# EAGLE schematic Resistor_Resistor (EAGLE 8.3.0), part 4 of 43
## Parts (continued)
R4401  10K  RESISTOR_0201  [0201]
R4402  10K  RESISTOR_0201  [0201]
R4403  10K  RESISTOR_0201  [0201]
R4404  10K  RESISTOR_0201  [0201]
R4405  10K  RESISTOR_0201  [0201]
R4406  10K  RESISTOR_0201  [0201]
R4407  10K  RESISTOR_0201  [0201]
R4408  10K  RESISTOR_0201  [0201]
R4409  10K  RESISTOR_0201  [0201]
R4410  10K  RESISTOR_0201  [0201]
R4411  10K  RESISTOR_0201  [0201]
R4412  10K  RESISTOR_0201  [0201]
R4413  10K  RESISTOR_0201  [0201]
R4414  10K  RESISTOR_0201  [0201]
R4415  10K  RESISTOR_0201  [0201]
R4416  10K  RESISTOR_0201  [0201]
R4417  10K  RESISTOR_0201  [0201]
R4418  10K  RESISTOR_0201  [0201]
R4419  10K  RESISTOR_0201  [0201]
R4420  10K  RESISTOR_0201  [0201]
R4421  10K  RESISTOR_0201  [0201]
R4422  10K  RESISTOR_0201  [0201]
R4423  10K  RESISTOR_0201  [0201]
R4424  10K  RESISTOR_0201  [0201]
R4425  10K  RESISTOR_0201  [0201]
R4426  10K  RESISTOR_0201  [0201]
R4427  10K  RESISTOR_0201  [0201]
R4428  10K  RESISTOR_0201  [0201]
R4429  10K  RESISTOR_0201  [0201]
R4430  10K  RESISTOR_0201  [0201]
R4431  10K  RESISTOR_0201  [0201]
R4432  10K  RESISTOR_0201  [0201]
R4433  10K  RESISTOR_0201  [0201]
R4434  10K  RESISTOR_0201  [0201]
R4435  10K  RESISTOR_0201  [0201]
R4436  10K  RESISTOR_0201  [0201]
R4437  10K  RESISTOR_0201  [0201]
R4438  10K  RESISTOR_0201  [0201]
R4439  10K  RESISTOR_0201  [0201]
R4440  10K  RESISTOR_0201  [0201]
R4441  10K  RESISTOR_0201  [0201]
R4442  10K  RESISTOR_0201  [0201]
R4443  10K  RESISTOR_0201  [0201]
R4444  10K  RESISTOR_0201  [0201]
R4445  10K  RESISTOR_0201  [0201]
R4446  10K  RESISTOR_0201  [0201]
R4447  10K  RESISTOR_0201  [0201]
R4448  10K  RESISTOR_0201  [0201]
R4449  10K  RESISTOR_0201  [0201]
R4450  10K  RESISTOR_0201  [0201]
R4451  10K  RESISTOR_0201  [0201]
R4452  10K  RESISTOR_0201  [0201]
R4453  10K  RESISTOR_0201  [0201]
R4454  10K  RESISTOR_0201  [0201]
R4455  10K  RESISTOR_0201  [0201]
R4456  10K  RESISTOR_0201  [0201]
R4457  10K  RESISTOR_0201  [0201]
R4458  10K  RESISTOR_0201  [0201]
R4459  10K  RESISTOR_0201  [0201]
R4460  10K  RESISTOR_0201  [0201]
R4461  10K  RESISTOR_0201  [0201]
R4462  10K  RESISTOR_0201  [0201]
R4463  10K  RESISTOR_0201  [0201]
R4464  10K  RESISTOR_0201  [0201]
R4465  10K  RESISTOR_0201  [0201]
R4466  10K  RESISTOR_0201  [0201]
R4467  10K  RESISTOR_0201  [0201]
R4468  10K  RESISTOR_0201  [0201]
R4469  10K  RESISTOR_0201  [0201]
R4470  10K  RESISTOR_0201  [0201]
R4471  10K  RESISTOR_0201  [0201]
R4472  10K  RESISTOR_0201  [0201]
R4473  10K  RESISTOR_0201  [0201]
R4474  10K  RESISTOR_0201  [0201]
R4475  10K  RESISTOR_0201  [0201]
R4476  10K  RESISTOR_0201  [0201]
R4477  10K  RESISTOR_0201  [0201]
R4478  10K  RESISTOR_0201  [0201]
R4479  10K  RESISTOR_0201  [0201]
R4480  10K  RESISTOR_0201  [0201]
R4481  10K  RESISTOR_0201  [0201]
R4482  10K  RESISTOR_0201  [0201]
R4483  10K  RESISTOR_0201  [0201]
R4484  10K  RESISTOR_0201  [0201]
R4485  10K  RESISTOR_0201  [0201]
R4486  10K  RESISTOR_0201  [0201]
R4487  10K  RESISTOR_0201  [0201]
R4488  10K  RESISTOR_0201  [0201]
R4489  10K  RESISTOR_0201  [0201]
R4490  10K  RESISTOR_0201  [0201]
R4491  10K  RESISTOR_0201  [0201]
R4492  10K  RESISTOR_0201  [0201]
R4493  10K  RESISTOR_0201  [0201]
R4494  10K  RESISTOR_0201  [0201]
R4495  10K  RESISTOR_0201  [0201]
R4496  10K  RESISTOR_0201  [0201]
R4497  10K  RESISTOR_0201  [0201]
R4498  10K  RESISTOR_0201  [0201]
R4499  10K  RESISTOR_0201  [0201]
R4500  10K  RESISTOR_0201  [0201]
R4501  10K  RESISTOR_0201  [0201]
R4502  10K  RESISTOR_0201  [0201]
R4503  10K  RESISTOR_0201  [0201]
R4504  10K  RESISTOR_0201  [0201]
R4505  10K  RESISTOR_0201  [0201]
R4506  10K  RESISTOR_0201  [0201]
R4507  10K  RESISTOR_0201  [0201]
R4508  10K  RESISTOR_0201  [0201]
R4509  10K  RESISTOR_0201  [0201]
R4510  10K  RESISTOR_0201  [0201]
R4511  10K  RESISTOR_0201  [0201]
R4512  10K  RESISTOR_0201  [0201]
R4513  10K  RESISTOR_0201  [0201]
R4514  10K  RESISTOR_0201  [0201]
R4515  10K  RESISTOR_0201  [0201]
R4516  10K  RESISTOR_0201  [0201]
R4517  10K  RESISTOR_0201  [0201]
R4518  10K  RESISTOR_0201  [0201]
R4519  10K  RESISTOR_0201  [0201]
R4520  10K  RESISTOR_0201  [0201]
R4521  10K  RESISTOR_0201  [0201]
R4522  10K  RESISTOR_0201  [0201]
R4523  10K  RESISTOR_0201  [0201]
R4524  10K  RESISTOR_0201  [0201]
R4525  10K  RESISTOR_0201  [0201]
R4526  10K  RESISTOR_0201  [0201]
R4527  10K  RESISTOR_0201  [0201]
R4528  10K  RESISTOR_0201  [0201]
R4529  10K  RESISTOR_0201  [0201]
R4530  10K  RESISTOR_0201  [0201]
R4531  10K  RESISTOR_0201  [0201]
R4532  10K  RESISTOR_0201  [0201]
R4533  10K  RESISTOR_0201  [0201]
R4534  10K  RESISTOR_0201  [0201]
R4535  10K  RESISTOR_0201  [0201]
R4536  10K  RESISTOR_0201  [0201]
R4537  10K  RESISTOR_0201  [0201]
R4538  10K  RESISTOR_0201  [0201]
R4539  10K  RESISTOR_0201  [0201]
R4540  10K  RESISTOR_0201  [0201]
R4541  10K  RESISTOR_0201  [0201]
R4542  10K  RESISTOR_0201  [0201]
R4543  10K  RESISTOR_0201  [0201]
R4544  10K  RESISTOR_0201  [0201]
R4545  10K  RESISTOR_0201  [0201]
R4546  10K  RESISTOR_0201  [0201]
R4547  10K  RESISTOR_0201  [0201]
R4548  10K  RESISTOR_0201  [0201]
R4549  10K  RESISTOR_0201  [0201]
R4550  10K  RESISTOR_0201  [0201]
R4551  10K  RESISTOR_0201  [0201]
R4552  10K  RESISTOR_0201  [0201]
R4553  10K  RESISTOR_0201  [0201]
R4554  10K  RESISTOR_0201  [0201]
R4555  10K  RESISTOR_0201  [0201]
R4556  10K  RESISTOR_0201  [0201]
R4557  10K  RESISTOR_0201  [0201]
R4558  10K  RESISTOR_0201  [0201]
R4559  10K  RESISTOR_0201  [0201]
R4560  10K  RESISTOR_0201  [0201]
R4561  10K  RESISTOR_0201  [0201]
R4562  10K  RESISTOR_0201  [0201]
R4563  10K  RESISTOR_0201  [0201]
R4564  10K  RESISTOR_0201  [0201]
R4565  10K  RESISTOR_0201  [0201]
R4566  10K  RESISTOR_0201  [0201]
R4567  10K  RESISTOR_0201  [0201]
R4568  10K  RESISTOR_0201  [0201]
R4569  10K  RESISTOR_0201  [0201]
R4570  10K  RESISTOR_0201  [0201]
R4571  10K  RESISTOR_0201  [0201]
R4572  10K  RESISTOR_0201  [0201]
R4573  10K  RESISTOR_0201  [0201]
R4574  10K  RESISTOR_0201  [0201]
R4575  10K  RESISTOR_0201  [0201]
R4576  10K  RESISTOR_0201  [0201]
R4577  10K  RESISTOR_0201  [0201]
R4578  10K  RESISTOR_0201  [0201]
R4579  10K  RESISTOR_0201  [0201]
R4580  10K  RESISTOR_0201  [0201]
R4581  10K  RESISTOR_0201  [0201]
R4582  10K  RESISTOR_0201  [0201]
R4583  10K  RESISTOR_0201  [0201]
R4584  10K  RESISTOR_0201  [0201]
R4585  10K  RESISTOR_0201  [0201]
R4586  10K  RESISTOR_0201  [0201]
R4587  10K  RESISTOR_0201  [0201]
R4588  10K  RESISTOR_0201  [0201]
R4589  10K  RESISTOR_0201  [0201]
R4590  10K  RESISTOR_0201  [0201]
R4591  10K  RESISTOR_0201  [0201]
R4592  10K  RESISTOR_0201  [0201]
R4593  10K  RESISTOR_0201  [0201]
R4594  10K  RESISTOR_0201  [0201]
R4595  10K  RESISTOR_0201  [0201]
R4596  10K  RESISTOR_0201  [0201]
R4597  10K  RESISTOR_0201  [0201]
R4598  10K  RESISTOR_0201  [0201]
R4599  10K  RESISTOR_0201  [0201]
R4600  10K  RESISTOR_0201  [0201]
R4601  10K  RESISTOR_0201  [0201]
R4602  10K  RESISTOR_0201  [0201]
R4603  10K  RESISTOR_0201  [0201]
R4604  10K  RESISTOR_0201  [0201]
R4605  10K  RESISTOR_0201  [0201]
R4606  10K  RESISTOR_0201  [0201]
R4607  10K  RESISTOR_0201  [0201]
R4608  10K  RESISTOR_0201  [0201]
R4609  10K  RESISTOR_0201  [0201]
R4610  10K  RESISTOR_0201  [0201]
R4611  10K  RESISTOR_0201  [0201]
R4612  10K  RESISTOR_0201  [0201]
R4613  10K  RESISTOR_0201  [0201]
R4614  10K  RESISTOR_0201  [0201]
R4615  10K  RESISTOR_0201  [0201]
R4616  10K  RESISTOR_0201  [0201]
R4617  10K  RESISTOR_0201  [0201]
R4618  10K  RESISTOR_0201  [0201]
R4619  10K  RESISTOR_0201  [0201]
R4620  10K  RESISTOR_0201  [0201]
R4621  10K  RESISTOR_0201  [0201]
R4622  10K  RESISTOR_0201  [0201]
R4623  10K  RESISTOR_0201  [0201]
R4624  10K  RESISTOR_0201  [0201]
R4625  10K  RESISTOR_0201  [0201]
R4626  10K  RESISTOR_0201  [0201]
R4627  10K  RESISTOR_0201  [0201]
R4628  10K  RESISTOR_0201  [0201]
R4629  10K  RESISTOR_0201  [0201]
R4630  10K  RESISTOR_0201  [0201]
R4631  10K  RESISTOR_0201  [0201]
R4632  10K  RESISTOR_0201  [0201]
R4633  10K  RESISTOR_0201  [0201]
R4634  10K  RESISTOR_0201  [0201]
R4635  10K  RESISTOR_0201  [0201]
R4636  10K  RESISTOR_0201  [0201]
R4637  10K  RESISTOR_0201  [0201]
R4638  10K  RESISTOR_0201  [0201]
R4639  10K  RESISTOR_0201  [0201]
R4640  10K  RESISTOR_0201  [0201]
R4641  10K  RESISTOR_0201  [0201]
R4642  10K  RESISTOR_0201  [0201]
R4643  10K  RESISTOR_0201  [0201]
R4644  10K  RESISTOR_0201  [0201]
R4645  10K  RESISTOR_0201  [0201]
R4646  10K  RESISTOR_0201  [0201]
R4647  10K  RESISTOR_0201  [0201]
R4648  10K  RESISTOR_0201  [0201]
R4649  10K  RESISTOR_0201  [0201]
R4650  10K  RESISTOR_0201  [0201]
R4651  10K  RESISTOR_0201  [0201]
R4652  10K  RESISTOR_0201  [0201]
R4653  10K  RESISTOR_0201  [0201]
R4654  10K  RESISTOR_0201  [0201]
R4655  10K  RESISTOR_0201  [0201]
R4656  10K  RESISTOR_0201  [0201]
R4657  10K  RESISTOR_0201  [0201]
R4658  10K  RESISTOR_0201  [0201]
R4659  10K  RESISTOR_0201  [0201]
R4660  10K  RESISTOR_0201  [0201]
R4661  10K  RESISTOR_0201  [0201]
R4662  10K  RESISTOR_0201  [0201]
R4663  10K  RESISTOR_0201  [0201]
R4664  10K  RESISTOR_0201  [0201]
R4665  10K  RESISTOR_0201  [0201]
R4666  10K  RESISTOR_0201  [0201]
R4667  10K  RESISTOR_0201  [0201]
R4668  10K  RESISTOR_0201  [0201]
R4669  10K  RESISTOR_0201  [0201]
R4670  10K  RESISTOR_0201  [0201]
R4671  10K  RESISTOR_0201  [0201]
R4672  10K  RESISTOR_0201  [0201]
R4673  10K  RESISTOR_0201  [0201]
R4674  10K  RESISTOR_0201  [0201]
R4675  10K  RESISTOR_0201  [0201]
R4676  10K  RESISTOR_0201  [0201]
R4677  10K  RESISTOR_0201  [0201]
R4678  10K  RESISTOR_0201  [0201]
R4679  10K  RESISTOR_0201  [0201]
R4680  10K  RESISTOR_0201  [0201]
R4681  10K  RESISTOR_0201  [0201]
R4682  10K  RESISTOR_0201  [0201]
R4683  10K  RESISTOR_0201  [0201]
R4684  10K  RESISTOR_0201  [0201]
R4685  10K  RESISTOR_0201  [0201]
R4686  10K  RESISTOR_0201  [0201]
R4687  10K  RESISTOR_0201  [0201]
R4688  10K  RESISTOR_0201  [0201]
R4689  10K  RESISTOR_0201  [0201]
R4690  10K  RESISTOR_0201  [0201]
R4691  10K  RESISTOR_0201  [0201]
R4692  10K  RESISTOR_0201  [0201]
R4693  10K  RESISTOR_0201  [0201]
R4694  10K  RESISTOR_0201  [0201]
R4695  10K  RESISTOR_0201  [0201]
R4696  10K  RESISTOR_0201  [0201]
R4697  10K  RESISTOR_0201  [0201]
R4698  10K  RESISTOR_0201  [0201]
R4699  10K  RESISTOR_0201  [0201]
R4700  10K  RESISTOR_0201  [0201]
R4701  10K  RESISTOR_0201  [0201]
R4702  10K  RESISTOR_0201  [0201]
R4703  10K  RESISTOR_0201  [0201]
R4704  10K  RESISTOR_0201  [0201]
R4705  10K  RESISTOR_0201  [0201]
R4706  10K  RESISTOR_0201  [0201]
R4707  10K  RESISTOR_0201  [0201]
R4708  10K  RESISTOR_0201  [0201]
R4709  10K  RESISTOR_0201  [0201]
R4710  10K  RESISTOR_0201  [0201]
R4711  10K  RESISTOR_0201  [0201]
R4712  10K  RESISTOR_0201  [0201]
R4713  10K  RESISTOR_0201  [0201]
R4714  10K  RESISTOR_0201  [0201]
R4715  10K  RESISTOR_0201  [0201]
R4716  10K  RESISTOR_0201  [0201]
R4717  10K  RESISTOR_0201  [0201]
R4718  10K  RESISTOR_0201  [0201]
R4719  10K  RESISTOR_0201  [0201]
R4720  10K  RESISTOR_0201  [0201]
R4721  10K  RESISTOR_0201  [0201]
R4722  10K  RESISTOR_0201  [0201]
R4723  10K  RESISTOR_0201  [0201]
R4724  10K  RESISTOR_0201  [0201]
R4725  10K  RESISTOR_0201  [0201]
R4726  10K  RESISTOR_0201  [0201]
R4727  10K  RESISTOR_0201  [0201]
R4728  10K  RESISTOR_0201  [0201]
R4729  10K  RESISTOR_0201  [0201]
R4730  10K  RESISTOR_0201  [0201]
R4731  10K  RESISTOR_0201  [0201]
R4732  10K  RESISTOR_0201  [0201]
R4733  10K  RESISTOR_0201  [0201]
R4734  10K  RESISTOR_0201  [0201]
R4735  10K  RESISTOR_0201  [0201]
R4736  10K  RESISTOR_0201  [0201]
R4737  10K  RESISTOR_0201  [0201]
R4738  10K  RESISTOR_0201  [0201]
R4739  10K  RESISTOR_0201  [0201]
R4740  10K  RESISTOR_0201  [0201]
R4741  10K  RESISTOR_0201  [0201]
R4742  10K  RESISTOR_0201  [0201]
R4743  10K  RESISTOR_0201  [0201]
R4744  10K  RESISTOR_0201  [0201]
R4745  10K  RESISTOR_0201  [0201]
R4746  10K  RESISTOR_0201  [0201]
R4747  10K  RESISTOR_0201  [0201]
R4748  10K  RESISTOR_0201  [0201]
R4749  10K  RESISTOR_0201  [0201]
R4750  10K  RESISTOR_0201  [0201]
R4751  10K  RESISTOR_0201  [0201]
R4752  10K  RESISTOR_0201  [0201]
R4753  10K  RESISTOR_0201  [0201]
R4754  10K  RESISTOR_0201  [0201]
R4755  10K  RESISTOR_0201  [0201]
R4756  10K  RESISTOR_0201  [0201]
R4757  10K  RESISTOR_0201  [0201]
R4758  10K  RESISTOR_0201  [0201]
R4759  10K  RESISTOR_0201  [0201]
R4760  10K  RESISTOR_0201  [0201]
R4761  10K  RESISTOR_0201  [0201]
R4762  10K  RESISTOR_0201  [0201]
R4763  10K  RESISTOR_0201  [0201]
R4764  10K  RESISTOR_0201  [0201]
R4765  10K  RESISTOR_0201  [0201]
R4766  10K  RESISTOR_0201  [0201]
R4767  10K  RESISTOR_0201  [0201]
R4768  10K  RESISTOR_0201  [0201]
R4769  10K  RESISTOR_0201  [0201]
R4770  10K  RESISTOR_0201  [0201]
R4771  10K  RESISTOR_0201  [0201]
R4772  10K  RESISTOR_0201  [0201]
R4773  10K  RESISTOR_0201  [0201]
R4774  10K  RESISTOR_0201  [0201]
R4775  10K  RESISTOR_0201  [0201]
R4776  10K  RESISTOR_0201  [0201]
R4777  10K  RESISTOR_0201  [0201]
R4778  10K  RESISTOR_0201  [0201]
R4779  10K  RESISTOR_0201  [0201]
R4780  10K  RESISTOR_0201  [0201]
R4781  10K  RESISTOR_0201  [0201]
R4782  10K  RESISTOR_0201  [0201]
R4783  10K  RESISTOR_0201  [0201]
R4784  10K  RESISTOR_0201  [0201]
R4785  10K  RESISTOR_0201  [0201]
R4786  10K  RESISTOR_0201  [0201]
R4787  10K  RESISTOR_0201  [0201]
R4788  10K  RESISTOR_0201  [0201]
R4789  10K  RESISTOR_0201  [0201]
R4790  10K  RESISTOR_0201  [0201]
R4791  10K  RESISTOR_0201  [0201]
R4792  10K  RESISTOR_0201  [0201]
R4793  10K  RESISTOR_0201  [0201]
R4794  10K  RESISTOR_0201  [0201]
R4795  10K  RESISTOR_0201  [0201]
R4796  10K  RESISTOR_0201  [0201]
R4797  10K  RESISTOR_0201  [0201]
R4798  10K  RESISTOR_0201  [0201]
R4799  10K  RESISTOR_0201  [0201]
R4800  10K  RESISTOR_0201  [0201]
R4801  10K  RESISTOR_0201  [0201]
R4802  10K  RESISTOR_0201  [0201]
R4803  10K  RESISTOR_0201  [0201]
R4804  10K  RESISTOR_0201  [0201]
R4805  10K  RESISTOR_0201  [0201]
R4806  10K  RESISTOR_0201  [0201]
R4807  10K  RESISTOR_0201  [0201]
R4808  10K  RESISTOR_0201  [0201]
R4809  10K  RESISTOR_0201  [0201]
R4810  10K  RESISTOR_0201  [0201]
R4811  10K  RESISTOR_0201  [0201]
R4812  10K  RESISTOR_0201  [0201]
R4813  10K  RESISTOR_0201  [0201]
R4814  10K  RESISTOR_0201  [0201]
R4815  10K  RESISTOR_0201  [0201]
R4816  10K  RESISTOR_0201  [0201]
R4817  10K  RESISTOR_0201  [0201]
R4818  10K  RESISTOR_0201  [0201]
R4819  10K  RESISTOR_0201  [0201]
R4820  10K  RESISTOR_0201  [0201]
R4821  10K  RESISTOR_0201  [0201]
R4822  10K  RESISTOR_0201  [0201]
R4823  10K  RESISTOR_0201  [0201]
R4824  10K  RESISTOR_0201  [0201]
R4825  10K  RESISTOR_0201  [0201]
R4826  10K  RESISTOR_0201  [0201]
R4827  10K  RESISTOR_0201  [0201]
R4828  10K  RESISTOR_0201  [0201]
R4829  10K  RESISTOR_0201  [0201]
R4830  10K  RESISTOR_0201  [0201]
R4831  10K  RESISTOR_0201  [0201]
R4832  10K  RESISTOR_0201  [0201]
R4833  10K  RESISTOR_0201  [0201]
R4834  10K  RESISTOR_0201  [0201]
R4835  10K  RESISTOR_0201  [0201]
R4836  10K  RESISTOR_0201  [0201]
R4837  10K  RESISTOR_0201  [0201]
R4838  10K  RESISTOR_0201  [0201]
R4839  10K  RESISTOR_0201  [0201]
R4840  10K  RESISTOR_0201  [0201]
R4841  10K  RESISTOR_0201  [0201]
R4842  10K  RESISTOR_0201  [0201]
R4843  10K  RESISTOR_0201  [0201]
R4844  10K  RESISTOR_0201  [0201]
R4845  10K  RESISTOR_0201  [0201]
R4846  10K  RESISTOR_0201  [0201]
R4847  10K  RESISTOR_0201  [0201]
R4848  10K  RESISTOR_0201  [0201]
R4849  10K  RESISTOR_0201  [0201]
R4850  10K  RESISTOR_0201  [0201]
R4851  10K  RESISTOR_0201  [0201]
R4852  10K  RESISTOR_0201  [0201]
R4853  10K  RESISTOR_0201  [0201]
R4854  10K  RESISTOR_0201  [0201]
R4855  10K  RESISTOR_0201  [0201]
R4856  10K  RESISTOR_0201  [0201]
R4857  10K  RESISTOR_0201  [0201]
R4858  10K  RESISTOR_0201  [0201]
R4859  10K  RESISTOR_0201  [0201]
R4860  10K  RESISTOR_0201  [0201]
R4861  10K  RESISTOR_0201  [0201]
R4862  10K  RESISTOR_0201  [0201]
R4863  10K  RESISTOR_0201  [0201]
R4864  10K  RESISTOR_0201  [0201]
R4865  10K  RESISTOR_0201  [0201]
R4866  10K  RESISTOR_0201  [0201]
R4867  10K  RESISTOR_0201  [0201]
R4868  10K  RESISTOR_0201  [0201]
R4869  10K  RESISTOR_0201  [0201]
R4870  10K  RESISTOR_0201  [0201]
R4871  10K  RESISTOR_0201  [0201]
R4872  10K  RESISTOR_0201  [0201]
R4873  10K  RESISTOR_0201  [0201]
R4874  10K  RESISTOR_0201  [0201]
R4875  10K  RESISTOR_0201  [0201]
R4876  10K  RESISTOR_0201  [0201]
R4877  10K  RESISTOR_0201  [0201]
R4878  10K  RESISTOR_0201  [0201]
R4879  10K  RESISTOR_0201  [0201]
R4880  10K  RESISTOR_0201  [0201]
R4881  10K  RESISTOR_0201  [0201]
R4882  10K  RESISTOR_0201  [0201]
R4883  10K  RESISTOR_0201  [0201]
R4884  10K  RESISTOR_0201  [0201]
R4885  10K  RESISTOR_0201  [0201]
R4886  10K  RESISTOR_0201  [0201]
R4887  10K  RESISTOR_0201  [0201]
R4888  10K  RESISTOR_0201  [0201]
R4889  10K  RESISTOR_0201  [0201]
R4890  10K  RESISTOR_0201  [0201]
R4891  10K  RESISTOR_0201  [0201]
R4892  10K  RESISTOR_0201  [0201]
R4893  10K  RESISTOR_0201  [0201]
R4894  10K  RESISTOR_0201  [0201]
R4895  10K  RESISTOR_0201  [0201]
R4896  10K  RESISTOR_0201  [0201]
R4897  10K  RESISTOR_0201  [0201]
R4898  10K  RESISTOR_0201  [0201]
R4899  10K  RESISTOR_0201  [0201]
R4900  10K  RESISTOR_0201  [0201]
R4901  10K  RESISTOR_0201  [0201]
R4902  10K  RESISTOR_0201  [0201]
R4903  10K  RESISTOR_0201  [0201]
R4904  10K  RESISTOR_0201  [0201]
R4905  10K  RESISTOR_0201  [0201]
R4906  10K  RESISTOR_0201  [0201]
R4907  10K  RESISTOR_0201  [0201]
R4908  10K  RESISTOR_0201  [0201]
R4909  10K  RESISTOR_0201  [0201]
R4910  10K  RESISTOR_0201  [0201]
R4911  10K  RESISTOR_0201  [0201]
R4912  10K  RESISTOR_0201  [0201]
R4913  10K  RESISTOR_0201  [0201]
R4914  10K  RESISTOR_0201  [0201]
R4915  10K  RESISTOR_0201  [0201]
R4916  10K  RESISTOR_0201  [0201]
R4917  10K  RESISTOR_0201  [0201]
R4918  10K  RESISTOR_0201  [0201]
R4919  10K  RESISTOR_0201  [0201]
R4920  10K  RESISTOR_0201  [0201]
R4921  10K  RESISTOR_0201  [0201]
R4922  10K  RESISTOR_0201  [0201]
R4923  10K  RESISTOR_0201  [0201]
R4924  10K  RESISTOR_0201  [0201]
R4925  10K  RESISTOR_0201  [0201]
R4926  10K  RESISTOR_0201  [0201]
R4927  10K  RESISTOR_0201  [0201]
R4928  10K  RESISTOR_0201  [0201]
R4929  10K  RESISTOR_0201  [0201]
R4930  10K  RESISTOR_0201  [0201]
R4931  10K  RESISTOR_0201  [0201]
R4932  10K  RESISTOR_0201  [0201]
R4933  10K  RESISTOR_0201  [0201]
R4934  10K  RESISTOR_0201  [0201]
R4935  10K  RESISTOR_0201  [0201]
R4936  10K  RESISTOR_0201  [0201]
R4937  10K  RESISTOR_0201  [0201]
R4938  10K  RESISTOR_0201  [0201]
R4939  10K  RESISTOR_0201  [0201]
R4940  10K  RESISTOR_0201  [0201]
R4941  10K  RESISTOR_0201  [0201]
R4942  10K  RESISTOR_0201  [0201]
R4943  10K  RESISTOR_0201  [0201]
R4944  10K  RESISTOR_0201  [0201]
R4945  10K  RESISTOR_0201  [0201]
R4946  10K  RESISTOR_0201  [0201]
R4947  10K  RESISTOR_0201  [0201]
R4948  10K  RESISTOR_0201  [0201]
R4949  10K  RESISTOR_0201  [0201]
R4950  10K  RESISTOR_0201  [0201]
R4951  10K  RESISTOR_0201  [0201]
R4952  10K  RESISTOR_0201  [0201]
R4953  10K  RESISTOR_0201  [0201]
R4954  10K  RESISTOR_0201  [0201]
R4955  10K  RESISTOR_0201  [0201]
R4956  10K  RESISTOR_0201  [0201]
R4957  10K  RESISTOR_0201  [0201]
R4958  10K  RESISTOR_0201  [0201]
R4959  10K  RESISTOR_0201  [0201]
R4960  10K  RESISTOR_0201  [0201]
R4961  10K  RESISTOR_0201  [0201]
R4962  10K  RESISTOR_0201  [0201]
R4963  10K  RESISTOR_0201  [0201]
R4964  10K  RESISTOR_0201  [0201]
R4965  10K  RESISTOR_0201  [0201]
R4966  10K  RESISTOR_0201  [0201]
R4967  10K  RESISTOR_0201  [0201]
R4968  10K  RESISTOR_0201  [0201]
R4969  10K  RESISTOR_0201  [0201]
R4970  10K  RESISTOR_0201  [0201]
R4971  10K  RESISTOR_0201  [0201]
R4972  10K  RESISTOR_0201  [0201]
R4973  10K  RESISTOR_0201  [0201]
R4974  10K  RESISTOR_0201  [0201]
R4975  10K  RESISTOR_0201  [0201]
R4976  10K  RESISTOR_0201  [0201]
R4977  10K  RESISTOR_0201  [0201]
R4978  10K  RESISTOR_0201  [0201]
R4979  10K  RESISTOR_0201  [0201]
R4980  10K  RESISTOR_0201  [0201]
R4981  10K  RESISTOR_0201  [0201]
R4982  10K  RESISTOR_0201  [0201]
R4983  10K  RESISTOR_0201  [0201]
R4984  10K  RESISTOR_0201  [0201]
R4985  10K  RESISTOR_0201  [0201]
R4986  10K  RESISTOR_0201  [0201]
R4987  10K  RESISTOR_0201  [0201]
R4988  10K  RESISTOR_0201  [0201]
R4989  10K  RESISTOR_0201  [0201]
R4990  10K  RESISTOR_0201  [0201]
R4991  10K  RESISTOR_0201  [0201]
R4992  10K  RESISTOR_0201  [0201]
R4993  10K  RESISTOR_0201  [0201]
R4994  10K  RESISTOR_0201  [0201]
R4995  10K  RESISTOR_0201  [0201]
R4996  10K  RESISTOR_0201  [0201]
R4997  10K  RESISTOR_0201  [0201]
R4998  10K  RESISTOR_0201  [0201]
R4999  10K  RESISTOR_0201  [0201]
R5000  10K  RESISTOR_0201  [0201]
R5001  10K  RESISTOR_0201  [0201]
R5002  10K  RESISTOR_0201  [0201]
R5003  10K  RESISTOR_0201  [0201]
R5004  10K  RESISTOR_0201  [0201]
R5005  10K  RESISTOR_0201  [0201]
R5006  10K  RESISTOR_0201  [0201]
R5007  10K  RESISTOR_0201  [0201]
R5008  10K  RESISTOR_0201  [0201]
R5009  10K  RESISTOR_0201  [0201]
R5010  10K  RESISTOR_0201  [0201]
R5011  10K  RESISTOR_0201  [0201]
R5012  10K  RESISTOR_0201  [0201]
R5013  10K  RESISTOR_0201  [0201]
R5014  10K  RESISTOR_0201  [0201]
R5015  10K  RESISTOR_0201  [0201]
R5016  10K  RESISTOR_0201  [0201]
R5017  10K  RESISTOR_0201  [0201]
R5018  10K  RESISTOR_0201  [0201]
R5019  10K  RESISTOR_0201  [0201]
R5020  10K  RESISTOR_0201  [0201]
R5021  10K  RESISTOR_0201  [0201]
R5022  10K  RESISTOR_0201  [0201]
R5023  10K  RESISTOR_0201  [0201]
R5024  10K  RESISTOR_0201  [0201]
R5025  10K  RESISTOR_0201  [0201]
R5026  10K  RESISTOR_0201  [0201]
R5027  10K  RESISTOR_0201  [0201]
R5028  10K  RESISTOR_0201  [0201]
R5029  10K  RESISTOR_0201  [0201]
R5030  10K  RESISTOR_0201  [0201]
R5031  10K  RESISTOR_0201  [0201]
R5032  10K  RESISTOR_0201  [0201]
R5033  10K  RESISTOR_0201  [0201]
R5034  10K  RESISTOR_0201  [0201]
R5035  10K  RESISTOR_0201  [0201]
R5036  10K  RESISTOR_0201  [0201]
R5037  10K  RESISTOR_0201  [0201]
R5038  10K  RESISTOR_0201  [0201]
R5039  10K  RESISTOR_0201  [0201]
R5040  10K  RESISTOR_0201  [0201]
R5041  10K  RESISTOR_0201  [0201]
R5042  10K  RESISTOR_0201  [0201]
R5043  10K  RESISTOR_0201  [0201]
R5044  10K  RESISTOR_0201  [0201]
R5045  10K  RESISTOR_0201  [0201]
R5046  10K  RESISTOR_0201  [0201]
R5047  10K  RESISTOR_0201  [0201]
R5048  10K  RESISTOR_0201  [0201]
R5049  10K  RESISTOR_0201  [0201]
R5050  10K  RESISTOR_0201  [0201]
R5051  10K  RESISTOR_0201  [0201]
R5052  10K  RESISTOR_0201  [0201]
R5053  10K  RESISTOR_0201  [0201]
R5054  10K  RESISTOR_0201  [0201]
R5055  10K  RESISTOR_0201  [0201]
R5056  10K  RESISTOR_0201  [0201]
R5057  10K  RESISTOR_0201  [0201]
R5058  10K  RESISTOR_0201  [0201]
R5059  10K  RESISTOR_0201  [0201]
R5060  10K  RESISTOR_0201  [0201]
R5061  10K  RESISTOR_0201  [0201]
R5062  10K  RESISTOR_0201  [0201]
R5063  10K  RESISTOR_0201  [0201]
R5064  10K  RESISTOR_0201  [0201]
R5065  10K  RESISTOR_0201  [0201]
R5066  10K  RESISTOR_0201  [0201]
R5067  10K  RESISTOR_0201  [0201]
R5068  10K  RESISTOR_0201  [0201]
R5069  10K  RESISTOR_0201  [0201]
R5070  10K  RESISTOR_0201  [0201]
R5071  10K  RESISTOR_0201  [0201]
R5072  10K  RESISTOR_0201  [0201]
R5073  10K  RESISTOR_0201  [0201]
R5074  10K  RESISTOR_0201  [0201]
R5075  10K  RESISTOR_0201  [0201]
R5076  10K  RESISTOR_0201  [0201]
R5077  10K  RESISTOR_0201  [0201]
R5078  10K  RESISTOR_0201  [0201]
R5079  10K  RESISTOR_0201  [0201]
R5080  10K  RESISTOR_0201  [0201]
R5081  10K  RESISTOR_0201  [0201]
R5082  10K  RESISTOR_0201  [0201]
R5083  10K  RESISTOR_0201  [0201]
R5084  10K  RESISTOR_0201  [0201]
R5085  10K  RESISTOR_0201  [0201]
R5086  10K  RESISTOR_0201  [0201]
R5087  10K  RESISTOR_0201  [0201]
R5088  10K  RESISTOR_0201  [0201]
R5089  10K  RESISTOR_0201  [0201]
R5090  10K  RESISTOR_0201  [0201]
R5091  10K  RESISTOR_0201  [0201]
R5092  10K  RESISTOR_0201  [0201]
R5093  10K  RESISTOR_0201  [0201]
R5094  10K  RESISTOR_0201  [0201]
R5095  10K  RESISTOR_0201  [0201]
R5096  10K  RESISTOR_0201  [0201]
R5097  10K  RESISTOR_0201  [0201]
R5098  10K  RESISTOR_0201  [0201]
R5099  10K  RESISTOR_0201  [0201]
R5100  10K  RESISTOR_0201  [0201]
R5101  10K  RESISTOR_0201  [0201]
R5102  10K  RESISTOR_0201  [0201]
R5103  10K  RESISTOR_0201  [0201]
R5104  10K  RESISTOR_0201  [0201]
R5105  10K  RESISTOR_0201  [0201]
R5106  10K  RESISTOR_0201  [0201]
R5107  10K  RESISTOR_0201  [0201]
R5108  10K  RESISTOR_0201  [0201]
R5109  10K  RESISTOR_0201  [0201]
R5110  10K  RESISTOR_0201  [0201]
R5111  10K  RESISTOR_0201  [0201]
R5112  10K  RESISTOR_0201  [0201]
R5113  10K  RESISTOR_0201  [0201]
R5114  10K  RESISTOR_0201  [0201]
R5115  10K  RESISTOR_0201  [0201]
R5116  10K  RESISTOR_0201  [0201]
R5117  10K  RESISTOR_0201  [0201]
R5118  10K  RESISTOR_0201  [0201]
R5119  10K  RESISTOR_0201  [0201]
R5120  10K  RESISTOR_0201  [0201]
R5121  10K  RESISTOR_0201  [0201]
R5122  10K  RESISTOR_0201  [0201]
R5123  10K  RESISTOR_0201  [0201]
R5124  10K  RESISTOR_0201  [0201]
R5125  10K  RESISTOR_0201  [0201]
R5126  10K  RESISTOR_0201  [0201]
R5127  10K  RESISTOR_0201  [0201]
R5128  10K  RESISTOR_0201  [0201]
R5129  10K  RESISTOR_0201  [0201]
R5130  10K  RESISTOR_0201  [0201]